# EAGLE schematic Resistor_Resistor (EAGLE 8.3.0), part 4 of 43 (continued)
## Parts (continued)
R5131  10K  RESISTOR_0201  [0201]
R5132  10K  RESISTOR_0201  [0201]
R5133  10K  RESISTOR_0201  [0201]
R5134  10K  RESISTOR_0201  [0201]
R5135  10K  RESISTOR_0201  [0201]
R5136  10K  RESISTOR_0201  [0201]
R5137  10K  RESISTOR_0201  [0201]
R5138  10K  RESISTOR_0201  [0201]
R5139  10K  RESISTOR_0201  [0201]
R5140  10K  RESISTOR_0201  [0201]
R5141  10K  RESISTOR_0201  [0201]
R5142  10K  RESISTOR_0201  [0201]
R5143  10K  RESISTOR_0201  [0201]
R5144  10K  RESISTOR_0201  [0201]
R5145  10K  RESISTOR_0201  [0201]
R5146  10K  RESISTOR_0201  [0201]
R5147  10K  RESISTOR_0201  [0201]
R5148  10K  RESISTOR_0201  [0201]
R5149  10K  RESISTOR_0201  [0201]
R5150  10K  RESISTOR_0201  [0201]
R5151  10K  RESISTOR_0201  [0201]
R5152  10K  RESISTOR_0201  [0201]
R5153  10K  RESISTOR_0201  [0201]
R5154  10K  RESISTOR_0201  [0201]
R5155  10K  RESISTOR_0201  [0201]
R5156  10K  RESISTOR_0201  [0201]
R5157  10K  RESISTOR_0201  [0201]
R5158  10K  RESISTOR_0201  [0201]
R5159  10K  RESISTOR_0201  [0201]
R5160  10K  RESISTOR_0201  [0201]
R5161  10K  RESISTOR_0201  [0201]
R5162  10K  RESISTOR_0201  [0201]
R5163  10K  RESISTOR_0201  [0201]
R5164  10K  RESISTOR_0201  [0201]
R5165  10K  RESISTOR_0201  [0201]
R5166  10K  RESISTOR_0201  [0201]
R5167  10K  RESISTOR_0201  [0201]
R5168  10K  RESISTOR_0201  [0201]
R5169  10K  RESISTOR_0201  [0201]
R5170  10K  RESISTOR_0201  [0201]
R5171  10K  RESISTOR_0201  [0201]
R5172  10K  RESISTOR_0201  [0201]
R5173  10K  RESISTOR_0201  [0201]
R5174  10K  RESISTOR_0201  [0201]
R5175  10K  RESISTOR_0201  [0201]
R5176  10K  RESISTOR_0201  [0201]
R5177  10K  RESISTOR_0201  [0201]
R5178  10K  RESISTOR_0201  [0201]
R5179  10K  RESISTOR_0201  [0201]
R5180  10K  RESISTOR_0201  [0201]
R5181  10K  RESISTOR_0201  [0201]
R5182  10K  RESISTOR_0201  [0201]
R5183  10K  RESISTOR_0201  [0201]
R5184  10K  RESISTOR_0201  [0201]
R5185  10K  RESISTOR_0201  [0201]
R5186  10K  RESISTOR_0201  [0201]
R5187  10K  RESISTOR_0201  [0201]
R5188  10K  RESISTOR_0201  [0201]
R5189  10K  RESISTOR_0201  [0201]
R5190  10K  RESISTOR_0201  [0201]
R5191  10K  RESISTOR_0201  [0201]
R5192  10K  RESISTOR_0201  [0201]
R5193  10K  RESISTOR_0201  [0201]
R5194  10K  RESISTOR_0201  [0201]
R5195  10K  RESISTOR_0201  [0201]
R5196  10K  RESISTOR_0201  [0201]
R5197  10K  RESISTOR_0201  [0201]
R5198  10K  RESISTOR_0201  [0201]
R5199  10K  RESISTOR_0201  [0201]
R5200  10K  RESISTOR_0201  [0201]
R5201  10K  RESISTOR_0201  [0201]
R5202  10K  RESISTOR_0201  [0201]
R5203  10K  RESISTOR_0201  [0201]
R5204  10K  RESISTOR_0201  [0201]
R5205  10K  RESISTOR_0201  [0201]
R5206  10K  RESISTOR_0201  [0201]
R5207  10K  RESISTOR_0201  [0201]
R5208  10K  RESISTOR_0201  [0201]
R5209  10K  RESISTOR_0201  [0201]
R5210  10K  RESISTOR_0201  [0201]
R5211  10K  RESISTOR_0201  [0201]
R5212  10K  RESISTOR_0201  [0201]
R5213  10K  RESISTOR_0201  [0201]
R5214  10K  RESISTOR_0201  [0201]
R5215  10K  RESISTOR_0201  [0201]
R5216  10K  RESISTOR_0201  [0201]
R5217  10K  RESISTOR_0201  [0201]
R5218  10K  RESISTOR_0201  [0201]
R5219  10K  RESISTOR_0201  [0201]
R5220  10K  RESISTOR_0201  [0201]
R5221  10K  RESISTOR_0201  [0201]
R5222  10K  RESISTOR_0201  [0201]
R5223  10K  RESISTOR_0201  [0201]
R5224  10K  RESISTOR_0201  [0201]
R5225  10K  RESISTOR_0201  [0201]
R5226  10K  RESISTOR_0201  [0201]
R5227  10K  RESISTOR_0201  [0201]
R5228  10K  RESISTOR_0201  [0201]
R5229  10K  RESISTOR_0201  [0201]
R5230  10K  RESISTOR_0201  [0201]
R5231  10K  RESISTOR_0201  [0201]
R5232  10K  RESISTOR_0201  [0201]
R5233  10K  RESISTOR_0201  [0201]
R5234  10K  RESISTOR_0201  [0201]
R5235  10K  RESISTOR_0201  [0201]
R5236  10K  RESISTOR_0201  [0201]
R5237  10K  RESISTOR_0201  [0201]
R5238  10K  RESISTOR_0201  [0201]
R5239  10K  RESISTOR_0201  [0201]
R5240  10K  RESISTOR_0201  [0201]
R5241  10K  RESISTOR_0201  [0201]
R5242  10K  RESISTOR_0201  [0201]
R5243  10K  RESISTOR_0201  [0201]
R5244  10K  RESISTOR_0201  [0201]
R5245  10K  RESISTOR_0201  [0201]
R5246  10K  RESISTOR_0201  [0201]
R5247  10K  RESISTOR_0201  [0201]
R5248  10K  RESISTOR_0201  [0201]
R5249  10K  RESISTOR_0201  [0201]
R5250  10K  RESISTOR_0201  [0201]
R5251  10K  RESISTOR_0201  [0201]
R5252  10K  RESISTOR_0201  [0201]
R5253  10K  RESISTOR_0201  [0201]
R5254  10K  RESISTOR_0201  [0201]
R5255  10K  RESISTOR_0201  [0201]
R5256  10K  RESISTOR_0201  [0201]
R5257  10K  RESISTOR_0201  [0201]
R5258  10K  RESISTOR_0201  [0201]
R5259  10K  RESISTOR_0201  [0201]
R5260  10K  RESISTOR_0201  [0201]
R5261  10K  RESISTOR_0201  [0201]
R5262  10K  RESISTOR_0201  [0201]
R5263  10K  RESISTOR_0201  [0201]
R5264  10K  RESISTOR_0201  [0201]
R5265  10K  RESISTOR_0201  [0201]
R5266  10K  RESISTOR_0201  [0201]
R5267  10K  RESISTOR_0201  [0201]
R5268  10K  RESISTOR_0201  [0201]
R5269  10K  RESISTOR_0201  [0201]
R5270  10K  RESISTOR_0201  [0201]
R5271  10K  RESISTOR_0201  [0201]
R5272  10K  RESISTOR_0201  [0201]
R5273  10K  RESISTOR_0201  [0201]
R5274  10K  RESISTOR_0201  [0201]
R5275  10K  RESISTOR_0201  [0201]
R5276  10K  RESISTOR_0201  [0201]
R5277  10K  RESISTOR_0201  [0201]
R5278  10K  RESISTOR_0201  [0201]
R5279  10K  RESISTOR_0201  [0201]
R5280  10K  RESISTOR_0201  [0201]
R5281  10K  RESISTOR_0201  [0201]
R5282  10K  RESISTOR_0201  [0201]
R5283  10K  RESISTOR_0201  [0201]
R5284  10K  RESISTOR_0201  [0201]
R5285  10K  RESISTOR_0201  [0201]
R5286  10K  RESISTOR_0201  [0201]
R5287  10K  RESISTOR_0201  [0201]
R5288  10K  RESISTOR_0201  [0201]
R5289  10K  RESISTOR_0201  [0201]
R5290  10K  RESISTOR_0201  [0201]
R5291  10K  RESISTOR_0201  [0201]
R5292  10K  RESISTOR_0201  [0201]
R5293  10K  RESISTOR_0201  [0201]
R5294  10K  RESISTOR_0201  [0201]
R5295  10K  RESISTOR_0201  [0201]
R5296  10K  RESISTOR_0201  [0201]
R5297  10K  RESISTOR_0201  [0201]
R5298  10K  RESISTOR_0201  [0201]
R5299  10K  RESISTOR_0201  [0201]
R5300  10K  RESISTOR_0201  [0201]
R5301  10K  RESISTOR_0201  [0201]
R5302  10K  RESISTOR_0201  [0201]
R5303  10K  RESISTOR_0201  [0201]
R5304  10K  RESISTOR_0201  [0201]
R5305  10K  RESISTOR_0201  [0201]
R5306  10K  RESISTOR_0201  [0201]
R5307  10K  RESISTOR_0201  [0201]
R5308  10K  RESISTOR_0201  [0201]
R5309  10K  RESISTOR_0201  [0201]
R5310  10K  RESISTOR_0201  [0201]
R5311  10K  RESISTOR_0201  [0201]
R5312  10K  RESISTOR_0201  [0201]
R5313  10K  RESISTOR_0201  [0201]
R5314  10K  RESISTOR_0201  [0201]
R5315  10K  RESISTOR_0201  [0201]
R5316  10K  RESISTOR_0201  [0201]
R5317  10K  RESISTOR_0201  [0201]
R5318  10K  RESISTOR_0201  [0201]
R5319  10K  RESISTOR_0201  [0201]
R5320  10K  RESISTOR_0201  [0201]
R5321  10K  RESISTOR_0201  [0201]
R5322  10K  RESISTOR_0201  [0201]
R5323  10K  RESISTOR_0201  [0201]
R5324  10K  RESISTOR_0201  [0201]
R5325  10K  RESISTOR_0201  [0201]
R5326  10K  RESISTOR_0201  [0201]
R5327  10K  RESISTOR_0201  [0201]
R5328  10K  RESISTOR_0201  [0201]
R5329  10K  RESISTOR_0201  [0201]
R5330  10K  RESISTOR_0201  [0201]
R5331  10K  RESISTOR_0201  [0201]
R5332  10K  RESISTOR_0201  [0201]
R5333  10K  RESISTOR_0201  [0201]
R5334  10K  RESISTOR_0201  [0201]
R5335  10K  RESISTOR_0201  [0201]
R5336  10K  RESISTOR_0201  [0201]
R5337  10K  RESISTOR_0201  [0201]
R5338  10K  RESISTOR_0201  [0201]
R5339  10K  RESISTOR_0201  [0201]
R5340  10K  RESISTOR_0201  [0201]
R5341  10K  RESISTOR_0201  [0201]
R5342  10K  RESISTOR_0201  [0201]
R5343  10K  RESISTOR_0201  [0201]
R5344  10K  RESISTOR_0201  [0201]
R5345  10K  RESISTOR_0201  [0201]
R5346  10K  RESISTOR_0201  [0201]
R5347  10K  RESISTOR_0201  [0201]
R5348  10K  RESISTOR_0201  [0201]
R5349  10K  RESISTOR_0201  [0201]
R5350  10K  RESISTOR_0201  [0201]
R5351  10K  RESISTOR_0201  [0201]
R5352  10K  RESISTOR_0201  [0201]
R5353  10K  RESISTOR_0201  [0201]
R5354  10K  RESISTOR_0201  [0201]
R5355  10K  RESISTOR_0201  [0201]
R5356  10K  RESISTOR_0201  [0201]
R5357  10K  RESISTOR_0201  [0201]
R5358  10K  RESISTOR_0201  [0201]
R5359  10K  RESISTOR_0201  [0201]
R5360  10K  RESISTOR_0201  [0201]
R5361  10K  RESISTOR_0201  [0201]
R5362  10K  RESISTOR_0201  [0201]
R5363  10K  RESISTOR_0201  [0201]
R5364  10K  RESISTOR_0201  [0201]
R5365  10K  RESISTOR_0201  [0201]
R5366  10K  RESISTOR_0201  [0201]
R5367  10K  RESISTOR_0201  [0201]
R5368  10K  RESISTOR_0201  [0201]
R5369  10K  RESISTOR_0201  [0201]
R5370  10K  RESISTOR_0201  [0201]
R5371  10K  RESISTOR_0201  [0201]
R5372  10K  RESISTOR_0201  [0201]
R5373  10K  RESISTOR_0201  [0201]
R5374  10K  RESISTOR_0201  [0201]
R5375  10K  RESISTOR_0201  [0201]
R5376  10K  RESISTOR_0201  [0201]
R5377  10K  RESISTOR_0201  [0201]
R5378  10K  RESISTOR_0201  [0201]
R5379  10K  RESISTOR_0201  [0201]
R5380  10K  RESISTOR_0201  [0201]
R5381  10K  RESISTOR_0201  [0201]
R5382  10K  RESISTOR_0201  [0201]
R5383  10K  RESISTOR_0201  [0201]
R5384  10K  RESISTOR_0201  [0201]
R5385  10K  RESISTOR_0201  [0201]
R5386  10K  RESISTOR_0201  [0201]
R5387  10K  RESISTOR_0201  [0201]
R5388  10K  RESISTOR_0201  [0201]
R5389  10K  RESISTOR_0201  [0201]
R5390  10K  RESISTOR_0201  [0201]
R5391  10K  RESISTOR_0201  [0201]
R5392  10K  RESISTOR_0201  [0201]
R5393  10K  RESISTOR_0201  [0201]
R5394  10K  RESISTOR_0201  [0201]
R5395  10K  RESISTOR_0201  [0201]
R5396  10K  RESISTOR_0201  [0201]
R5397  10K  RESISTOR_0201  [0201]
R5398  10K  RESISTOR_0201  [0201]
R5399  10K  RESISTOR_0201  [0201]
R5400  10K  RESISTOR_0201  [0201]
R5401  10K  RESISTOR_0201  [0201]
R5402  10K  RESISTOR_0201  [0201]
R5403  10K  RESISTOR_0201  [0201]
R5404  10K  RESISTOR_0201  [0201]
R5405  10K  RESISTOR_0201  [0201]
R5406  10K  RESISTOR_0201  [0201]
R5407  10K  RESISTOR_0201  [0201]
R5408  10K  RESISTOR_0201  [0201]
R5409  10K  RESISTOR_0201  [0201]
R5410  10K  RESISTOR_0201  [0201]
R5411  10K  RESISTOR_0201  [0201]
R5412  10K  RESISTOR_0201  [0201]
R5413  10K  RESISTOR_0201  [0201]
R5414  10K  RESISTOR_0201  [0201]
R5415  10K  RESISTOR_0201  [0201]
R5416  10K  RESISTOR_0201  [0201]
R5417  10K  RESISTOR_0201  [0201]
R5418  10K  RESISTOR_0201  [0201]
R5419  10K  RESISTOR_0201  [0201]
R5420  10K  RESISTOR_0201  [0201]
R5421  10K  RESISTOR_0201  [0201]
R5422  10K  RESISTOR_0201  [0201]
R5423  10K  RESISTOR_0201  [0201]
R5424  10K  RESISTOR_0201  [0201]
R5425  10K  RESISTOR_0201  [0201]
R5426  10K  RESISTOR_0201  [0201]
R5427  10K  RESISTOR_0201  [0201]
R5428  10K  RESISTOR_0201  [0201]
R5429  10K  RESISTOR_0201  [0201]
R5430  10K  RESISTOR_0201  [0201]
R5431  10K  RESISTOR_0201  [0201]
R5432  10K  RESISTOR_0201  [0201]
R5433  10K  RESISTOR_0201  [0201]
R5434  10K  RESISTOR_0201  [0201]
R5435  10K  RESISTOR_0201  [0201]
R5436  10K  RESISTOR_0201  [0201]
R5437  10K  RESISTOR_0201  [0201]
R5438  10K  RESISTOR_0201  [0201]
R5439  10K  RESISTOR_0201  [0201]
R5440  10K  RESISTOR_0201  [0201]
R5441  10K  RESISTOR_0201  [0201]
R5442  10K  RESISTOR_0201  [0201]
R5443  10K  RESISTOR_0201  [0201]
R5444  10K  RESISTOR_0201  [0201]
R5445  10K  RESISTOR_0201  [0201]
R5446  10K  RESISTOR_0201  [0201]
R5447  10K  RESISTOR_0201  [0201]
R5448  10K  RESISTOR_0201  [0201]
R5449  10K  RESISTOR_0201  [0201]
R5450  10K  RESISTOR_0201  [0201]
R5451  10K  RESISTOR_0201  [0201]
R5452  10K  RESISTOR_0201  [0201]
R5453  10K  RESISTOR_0201  [0201]
R5454  10K  RESISTOR_0201  [0201]
R5455  10K  RESISTOR_0201  [0201]
R5456  10K  RESISTOR_0201  [0201]
R5457  10K  RESISTOR_0201  [0201]
R5458  10K  RESISTOR_0201  [0201]
R5459  10K  RESISTOR_0201  [0201]
R5460  10K  RESISTOR_0201  [0201]
R5461  10K  RESISTOR_0201  [0201]
R5462  10K  RESISTOR_0201  [0201]
R5463  10K  RESISTOR_0201  [0201]
R5464  10K  RESISTOR_0201  [0201]
R5465  10K  RESISTOR_0201  [0201]
R5466  10K  RESISTOR_0201  [0201]
R5467  10K  RESISTOR_0201  [0201]
R5468  10K  RESISTOR_0201  [0201]
R5469  10K  RESISTOR_0201  [0201]
R5470  10K  RESISTOR_0201  [0201]
R5471  10K  RESISTOR_0201  [0201]
R5472  10K  RESISTOR_0201  [0201]
R5473  10K  RESISTOR_0201  [0201]
R5474  10K  RESISTOR_0201  [0201]
R5475  10K  RESISTOR_0201  [0201]
R5476  10K  RESISTOR_0201  [0201]
R5477  10K  RESISTOR_0201  [0201]
R5478  10K  RESISTOR_0201  [0201]
R5479  10K  RESISTOR_0201  [0201]
R5480  10K  RESISTOR_0201  [0201]
R5481  10K  RESISTOR_0201  [0201]
R5482  10K  RESISTOR_0201  [0201]
R5483  10K  RESISTOR_0201  [0201]
R5484  10K  RESISTOR_0201  [0201]
R5485  10K  RESISTOR_0201  [0201]
R5486  10K  RESISTOR_0201  [0201]
R5487  10K  RESISTOR_0201  [0201]
R5488  10K  RESISTOR_0201  [0201]
R5489  10K  RESISTOR_0201  [0201]
R5490  10K  RESISTOR_0201  [0201]
R5491  10K  RESISTOR_0201  [0201]
R5492  10K  RESISTOR_0201  [0201]
R5493  10K  RESISTOR_0201  [0201]
R5494  10K  RESISTOR_0201  [0201]
R5495  10K  RESISTOR_0201  [0201]
R5496  10K  RESISTOR_0201  [0201]
R5497  10K  RESISTOR_0201  [0201]
R5498  10K  RESISTOR_0201  [0201]
R5499  10K  RESISTOR_0201  [0201]
R5500  10K  RESISTOR_0201  [0201]
R5501  10K  RESISTOR_0201  [0201]
R5502  10K  RESISTOR_0201  [0201]
R5503  10K  RESISTOR_0201  [0201]
R5504  10K  RESISTOR_0201  [0201]
R5505  10K  RESISTOR_0201  [0201]
R5506  10K  RESISTOR_0201  [0201]
R5507  10K  RESISTOR_0201  [0201]
R5508  10K  RESISTOR_0201  [0201]
R5509  10K  RESISTOR_0201  [0201]
R5510  10K  RESISTOR_0201  [0201]
R5511  10K  RESISTOR_0201  [0201]
R5512  10K  RESISTOR_0201  [0201]
R5513  10K  RESISTOR_0201  [0201]
R5514  10K  RESISTOR_0201  [0201]
R5515  10K  RESISTOR_0201  [0201]
R5516  10K  RESISTOR_0201  [0201]
R5517  10K  RESISTOR_0201  [0201]
R5518  10K  RESISTOR_0201  [0201]
R5519  10K  RESISTOR_0201  [0201]
R5520  10K  RESISTOR_0201  [0201]
R5521  10K  RESISTOR_0201  [0201]
R5522  10K  RESISTOR_0201  [0201]
R5523  10K  RESISTOR_0201  [0201]
R5524  10K  RESISTOR_0201  [0201]
R5525  10K  RESISTOR_0201  [0201]
R5526  10K  RESISTOR_0201  [0201]
R5527  10K  RESISTOR_0201  [0201]
R5528  10K  RESISTOR_0201  [0201]
R5529  10K  RESISTOR_0201  [0201]
R5530  10K  RESISTOR_0201  [0201]
R5531  10K  RESISTOR_0201  [0201]
R5532  10K  RESISTOR_0201  [0201]
R5533  10K  RESISTOR_0201  [0201]
R5534  10K  RESISTOR_0201  [0201]
R5535  10K  RESISTOR_0201  [0201]
R5536  10K  RESISTOR_0201  [0201]
R5537  10K  RESISTOR_0201  [0201]
R5538  10K  RESISTOR_0201  [0201]
R5539  10K  RESISTOR_0201  [0201]
R5540  10K  RESISTOR_0201  [0201]
R5541  10K  RESISTOR_0201  [0201]
R5542  10K  RESISTOR_0201  [0201]
R5543  10K  RESISTOR_0201  [0201]
R5544  10K  RESISTOR_0201  [0201]
R5545  10K  RESISTOR_0201  [0201]
R5546  10K  RESISTOR_0201  [0201]
R5547  10K  RESISTOR_0201  [0201]
R5548  10K  RESISTOR_0201  [0201]
R5549  10K  RESISTOR_0201  [0201]
R5550  10K  RESISTOR_0201  [0201]
R5551  10K  RESISTOR_0201  [0201]
R5552  10K  RESISTOR_0201  [0201]
R5553  10K  RESISTOR_0201  [0201]
R5554  10K  RESISTOR_0201  [0201]
R5555  10K  RESISTOR_0201  [0201]
R5556  10K  RESISTOR_0201  [0201]
R5557  10K  RESISTOR_0201  [0201]
R5558  10K  RESISTOR_0201  [0201]
R5559  10K  RESISTOR_0201  [0201]
R5560  10K  RESISTOR_0201  [0201]
R5561  10K  RESISTOR_0201  [0201]
R5562  10K  RESISTOR_0201  [0201]
R5563  10K  RESISTOR_0201  [0201]
R5564  10K  RESISTOR_0201  [0201]
R5565  10K  RESISTOR_0201  [0201]
R5566  10K  RESISTOR_0201  [0201]
R5567  10K  RESISTOR_0201  [0201]
R5568  10K  RESISTOR_0201  [0201]
R5569  10K  RESISTOR_0201  [0201]
R5570  10K  RESISTOR_0201  [0201]
R5571  10K  RESISTOR_0201  [0201]
R5572  10K  RESISTOR_0201  [0201]
R5573  10K  RESISTOR_0201  [0201]
R5574  10K  RESISTOR_0201  [0201]
R5575  10K  RESISTOR_0201  [0201]
R5576  10K  RESISTOR_0201  [0201]
R5577  10K  RESISTOR_0201  [0201]
R5578  10K  RESISTOR_0201  [0201]
R5579  10K  RESISTOR_0201  [0201]
R5580  10K  RESISTOR_0201  [0201]
R5581  10K  RESISTOR_0201  [0201]
R5582  10K  RESISTOR_0201  [0201]
R5583  10K  RESISTOR_0201  [0201]
R5584  10K  RESISTOR_0201  [0201]
R5585  10K  RESISTOR_0201  [0201]
R5586  10K  RESISTOR_0201  [0201]
R5587  10K  RESISTOR_0201  [0201]
R5588  10K  RESISTOR_0201  [0201]
R5589  10K  RESISTOR_0201  [0201]
R5590  10K  RESISTOR_0201  [0201]
R5591  10K  RESISTOR_0201  [0201]
R5592  10K  RESISTOR_0201  [0201]
R5593  10K  RESISTOR_0201  [0201]
R5594  10K  RESISTOR_0201  [0201]
R5595  10K  RESISTOR_0201  [0201]
R5596  10K  RESISTOR_0201  [0201]
R5597  10K  RESISTOR_0201  [0201]
R5598  10K  RESISTOR_0201  [0201]
R5599  10K  RESISTOR_0201  [0201]
R5600  10K  RESISTOR_0201  [0201]
R5601  10K  RESISTOR_0201  [0201]
R5602  10K  RESISTOR_0201  [0201]
R5603  10K  RESISTOR_0201  [0201]
R5604  10K  RESISTOR_0201  [0201]
R5605  10K  RESISTOR_0201  [0201]
R5606  10K  RESISTOR_0201  [0201]
R5607  10K  RESISTOR_0201  [0201]
R5608  10K  RESISTOR_0201  [0201]
R5609  10K  RESISTOR_0201  [0201]
R5610  10K  RESISTOR_0201  [0201]
R5611  10K  RESISTOR_0201  [0201]
R5612  10K  RESISTOR_0201  [0201]
R5613  10K  RESISTOR_0201  [0201]
R5614  10K  RESISTOR_0201  [0201]
R5615  10K  RESISTOR_0201  [0201]
R5616  10K  RESISTOR_0201  [0201]
R5617  10K  RESISTOR_0201  [0201]
R5618  10K  RESISTOR_0201  [0201]
R5619  10K  RESISTOR_0201  [0201]
R5620  10K  RESISTOR_0201  [0201]
R5621  10K  RESISTOR_0201  [0201]
R5622  10K  RESISTOR_0201  [0201]
R5623  10K  RESISTOR_0201  [0201]
R5624  10K  RESISTOR_0201  [0201]
R5625  10K  RESISTOR_0201  [0201]
R5626  10K  RESISTOR_0201  [0201]
R5627  10K  RESISTOR_0201  [0201]
R5628  10K  RESISTOR_0201  [0201]
R5629  10K  RESISTOR_0201  [0201]
R5630  10K  RESISTOR_0201  [0201]
R5631  10K  RESISTOR_0201  [0201]
R5632  10K  RESISTOR_0201  [0201]
R5633  10K  RESISTOR_0201  [0201]
R5634  10K  RESISTOR_0201  [0201]
R5635  10K  RESISTOR_0201  [0201]
R5636  10K  RESISTOR_0201  [0201]
R5637  10K  RESISTOR_0201  [0201]
R5638  10K  RESISTOR_0201  [0201]
R5639  10K  RESISTOR_0201  [0201]
R5640  10K  RESISTOR_0201  [0201]
R5641  10K  RESISTOR_0201  [0201]
R5642  10K  RESISTOR_0201  [0201]
R5643  10K  RESISTOR_0201  [0201]
R5644  10K  RESISTOR_0201  [0201]
R5645  10K  RESISTOR_0201  [0201]
R5646  10K  RESISTOR_0201  [0201]
R5647  10K  RESISTOR_0201  [0201]
R5648  10K  RESISTOR_0201  [0201]
R5649  10K  RESISTOR_0201  [0201]
R5650  10K  RESISTOR_0201  [0201]
R5651  10K  RESISTOR_0201  [0201]
R5652  10K  RESISTOR_0201  [0201]
R5653  10K  RESISTOR_0201  [0201]
R5654  10K  RESISTOR_0201  [0201]
R5655  10K  RESISTOR_0201  [0201]
R5656  10K  RESISTOR_0201  [0201]
R5657  10K  RESISTOR_0201  [0201]
R5658  10K  RESISTOR_0201  [0201]
R5659  10K  RESISTOR_0201  [0201]
R5660  10K  RESISTOR_0201  [0201]
R5661  10K  RESISTOR_0201  [0201]
R5662  10K  RESISTOR_0201  [0201]
R5663  10K  RESISTOR_0201  [0201]
R5664  10K  RESISTOR_0201  [0201]
R5665  10K  RESISTOR_0201  [0201]
R5666  10K  RESISTOR_0201  [0201]
R5667  10K  RESISTOR_0201  [0201]
R5668  10K  RESISTOR_0201  [0201]
R5669  10K  RESISTOR_0201  [0201]
R5670  10K  RESISTOR_0201  [0201]
R5671  10K  RESISTOR_0201  [0201]
R5672  10K  RESISTOR_0201  [0201]
R5673  10K  RESISTOR_0201  [0201]
R5674  10K  RESISTOR_0201  [0201]
R5675  10K  RESISTOR_0201  [0201]
R5676  10K  RESISTOR_0201  [0201]
R5677  10K  RESISTOR_0201  [0201]
R5678  10K  RESISTOR_0201  [0201]
R5679  10K  RESISTOR_0201  [0201]
R5680  10K  RESISTOR_0201  [0201]
R5681  10K  RESISTOR_0201  [0201]
R5682  10K  RESISTOR_0201  [0201]
R5683  10K  RESISTOR_0201  [0201]
R5684  10K  RESISTOR_0201  [0201]
R5685  10K  RESISTOR_0201  [0201]
R5686  10K  RESISTOR_0201  [0201]
R5687  10K  RESISTOR_0201  [0201]
R5688  10K  RESISTOR_0201  [0201]
R5689  10K  RESISTOR_0201  [0201]
R5690  10K  RESISTOR_0201  [0201]
R5691  10K  RESISTOR_0201  [0201]
R5692  10K  RESISTOR_0201  [0201]
R5693  10K  RESISTOR_0201  [0201]
R5694  10K  RESISTOR_0201  [0201]
R5695  10K  RESISTOR_0201  [0201]
R5696  10K  RESISTOR_0201  [0201]
R5697  10K  RESISTOR_0201  [0201]
R5698  10K  RESISTOR_0201  [0201]
R5699  10K  RESISTOR_0201  [0201]
R5700  10K  RESISTOR_0201  [0201]
R5701  10K  RESISTOR_0201  [0201]
R5702  10K  RESISTOR_0201  [0201]
R5703  10K  RESISTOR_0201  [0201]
R5704  10K  RESISTOR_0201  [0201]
R5705  10K  RESISTOR_0201  [0201]
R5706  10K  RESISTOR_0201  [0201]
R5707  10K  RESISTOR_0201  [0201]
R5708  10K  RESISTOR_0201  [0201]
R5709  10K  RESISTOR_0201  [0201]
R5710  10K  RESISTOR_0201  [0201]
R5711  10K  RESISTOR_0201  [0201]
R5712  10K  RESISTOR_0201  [0201]
R5713  10K  RESISTOR_0201  [0201]
R5714  10K  RESISTOR_0201  [0201]
R5715  10K  RESISTOR_0201  [0201]
R5716  10K  RESISTOR_0201  [0201]
R5717  10K  RESISTOR_0201  [0201]
R5718  10K  RESISTOR_0201  [0201]
R5719  10K  RESISTOR_0201  [0201]
R5720  10K  RESISTOR_0201  [0201]
R5721  10K  RESISTOR_0201  [0201]
R5722  10K  RESISTOR_0201  [0201]
R5723  10K  RESISTOR_0201  [0201]
R5724  10K  RESISTOR_0201  [0201]
R5725  10K  RESISTOR_0201  [0201]
R5726  10K  RESISTOR_0201  [0201]
R5727  10K  RESISTOR_0201  [0201]
R5728  10K  RESISTOR_0201  [0201]
R5729  10K  RESISTOR_0201  [0201]
R5730  10K  RESISTOR_0201  [0201]
R5731  10K  RESISTOR_0201  [0201]
R5732  10K  RESISTOR_0201  [0201]
R5733  10K  RESISTOR_0201  [0201]
R5734  10K  RESISTOR_0201  [0201]
R5735  10K  RESISTOR_0201  [0201]
R5736  10K  RESISTOR_0201  [0201]
R5737  10K  RESISTOR_0201  [0201]
R5738  10K  RESISTOR_0201  [0201]
R5739  10K  RESISTOR_0201  [0201]
R5740  10K  RESISTOR_0201  [0201]
R5741  10K  RESISTOR_0201  [0201]
R5742  10K  RESISTOR_0201  [0201]
R5743  10K  RESISTOR_0201  [0201]
R5744  10K  RESISTOR_0201  [0201]
R5745  10K  RESISTOR_0201  [0201]
R5746  10K  RESISTOR_0201  [0201]
R5747  10K  RESISTOR_0201  [0201]
R5748  10K  RESISTOR_0201  [0201]
R5749  10K  RESISTOR_0201  [0201]
R5750  10K  RESISTOR_0201  [0201]
R5751  10K  RESISTOR_0201  [0201]
R5752  10K  RESISTOR_0201  [0201]
R5753  10K  RESISTOR_0201  [0201]
R5754  10K  RESISTOR_0201  [0201]
R5755  10K  RESISTOR_0201  [0201]
R5756  10K  RESISTOR_0201  [0201]
R5757  10K  RESISTOR_0201  [0201]
R5758  10K  RESISTOR_0201  [0201]
R5759  10K  RESISTOR_0201  [0201]
R5760  10K  RESISTOR_0201  [0201]
R5761  10K  RESISTOR_0201  [0201]
R5762  10K  RESISTOR_0201  [0201]
R5763  10K  RESISTOR_0201  [0201]
R5764  10K  RESISTOR_0201  [0201]
R5765  10K  RESISTOR_0201  [0201]
R5766  10K  RESISTOR_0201  [0201]
R5767  10K  RESISTOR_0201  [0201]
R5768  10K  RESISTOR_0201  [0201]
R5769  10K  RESISTOR_0201  [0201]
R5770  10K  RESISTOR_0201  [0201]
R5771  10K  RESISTOR_0201  [0201]
R5772  10K  RESISTOR_0201  [0201]
R5773  10K  RESISTOR_0201  [0201]
R5774  10K  RESISTOR_0201  [0201]
R5775  10K  RESISTOR_0201  [0201]
R5776  10K  RESISTOR_0201  [0201]
R5777  10K  RESISTOR_0201  [0201]
R5778  10K  RESISTOR_0201  [0201]
R5779  10K  RESISTOR_0201  [0201]
R5780  10K  RESISTOR_0201  [0201]
R5781  10K  RESISTOR_0201  [0201]
R5782  10K  RESISTOR_0201  [0201]
R5783  10K  RESISTOR_0201  [0201]
R5784  10K  RESISTOR_0201  [0201]
R5785  10K  RESISTOR_0201  [0201]
R5786  10K  RESISTOR_0201  [0201]
R5787  10K  RESISTOR_0201  [0201]
R5788  10K  RESISTOR_0201  [0201]
R5789  10K  RESISTOR_0201  [0201]
R5790  10K  RESISTOR_0201  [0201]
R5791  10K  RESISTOR_0201  [0201]
R5792  10K  RESISTOR_0201  [0201]
R5793  10K  RESISTOR_0201  [0201]
R5794  10K  RESISTOR_0201  [0201]
R5795  10K  RESISTOR_0201  [0201]
R5796  10K  RESISTOR_0201  [0201]
R5797  10K  RESISTOR_0201  [0201]
R5798  10K  RESISTOR_0201  [0201]
R5799  10K  RESISTOR_0201  [0201]
R5800  10K  RESISTOR_0201  [0201]
R5801  10K  RESISTOR_0201  [0201]
R5802  10K  RESISTOR_0201  [0201]
R5803  10K  RESISTOR_0201  [0201]
R5804  10K  RESISTOR_0201  [0201]
R5805  10K  RESISTOR_0201  [0201]
R5806  10K  RESISTOR_0201  [0201]
R5807  10K  RESISTOR_0201  [0201]
R5808  10K  RESISTOR_0201  [0201]
R5809  10K  RESISTOR_0201  [0201]
R5810  10K  RESISTOR_0201  [0201]
R5811  10K  RESISTOR_0201  [0201]
R5812  10K  RESISTOR_0201  [0201]
R5813  10K  RESISTOR_0201  [0201]
R5814  10K  RESISTOR_0201  [0201]
R5815  10K  RESISTOR_0201  [0201]
R5816  10K  RESISTOR_0201  [0201]
R5817  10K  RESISTOR_0201  [0201]
R5818  10K  RESISTOR_0201  [0201]
R5819  10K  RESISTOR_0201  [0201]
R5820  10K  RESISTOR_0201  [0201]
R5821  10K  RESISTOR_0201  [0201]
R5822  10K  RESISTOR_0201  [0201]
R5823  10K  RESISTOR_0201  [0201]
R5824  10K  RESISTOR_0201  [0201]
R5825  10K  RESISTOR_0201  [0201]
R5826  10K  RESISTOR_0201  [0201]
R5827  10K  RESISTOR_0201  [0201]
R5828  10K  RESISTOR_0201  [0201]
R5829  10K  RESISTOR_0201  [0201]
R5830  10K  RESISTOR_0201  [0201]
R5831  10K  RESISTOR_0201  [0201]
R5832  10K  RESISTOR_0201  [0201]
R5833  10K  RESISTOR_0201  [0201]
R5834  10K  RESISTOR_0201  [0201]
R5835  10K  RESISTOR_0201  [0201]
R5836  10K  RESISTOR_0201  [0201]
R5837  10K  RESISTOR_0201  [0201]
R5838  10K  RESISTOR_0201  [0201]
R5839  10K  RESISTOR_0201  [0201]
R5840  10K  RESISTOR_0201  [0201]
R5841  10K  RESISTOR_0201  [0201]
R5842  10K  RESISTOR_0201  [0201]
R5843  10K  RESISTOR_0201  [0201]
R5844  10K  RESISTOR_0201  [0201]
R5845  10K  RESISTOR_0201  [0201]
R5846  10K  RESISTOR_0201  [0201]
R5847  10K  RESISTOR_0201  [0201]
R5848  10K  RESISTOR_0201  [0201]
R5849  10K  RESISTOR_0201  [0201]
R5850  10K  RESISTOR_0201  [0201]
R5851  10K  RESISTOR_0201  [0201]
R5852  10K  RESISTOR_0201  [0201]
R5853  10K  RESISTOR_0201  [0201]
R5854  10K  RESISTOR_0201  [0201]
R5855  10K  RESISTOR_0201  [0201]
R5856  10K  RESISTOR_0201  [0201]
R5857  10K  RESISTOR_0201  [0201]
R5858  10K  RESISTOR_0201  [0201]
R5859  10K  RESISTOR_0201  [0201]
R5860  10K  RESISTOR_0201  [0201]
R5861  10K  RESISTOR_0201  [0201]